# EasyEDA Pro project wukong01-Y003-HTOL - 2.eprj, board PCB1 (continued)
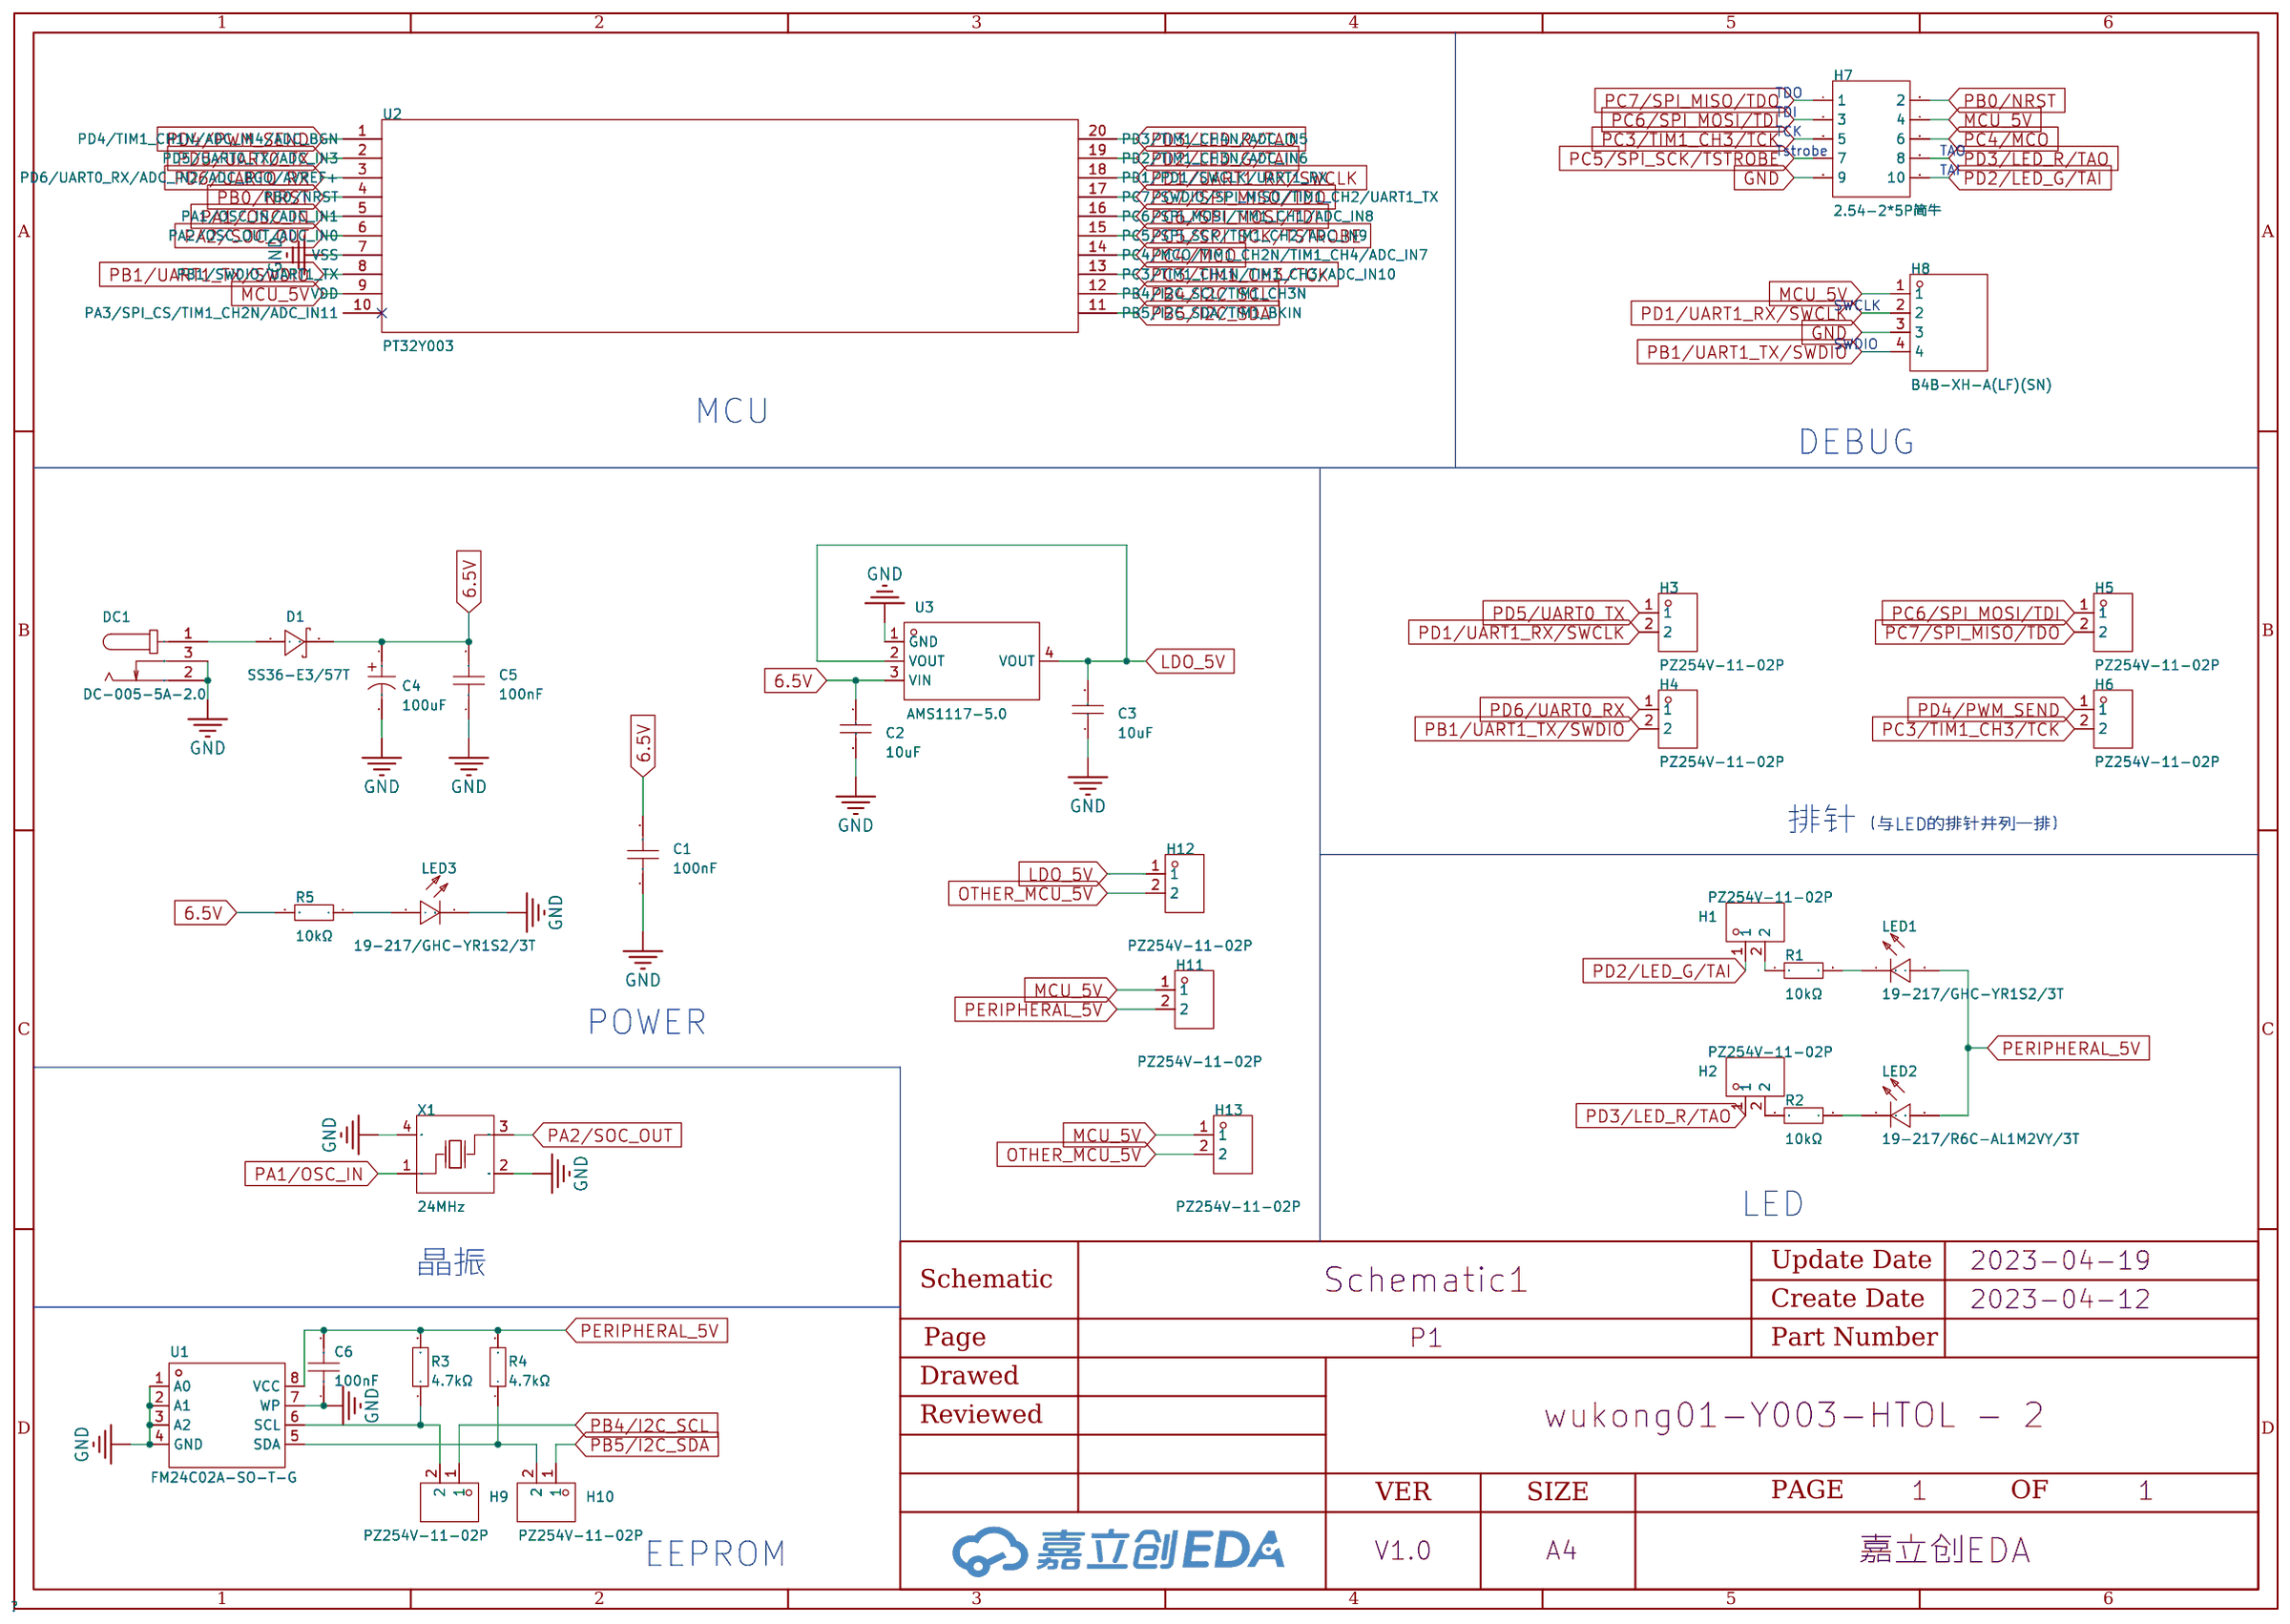
[diagram p0: schematic sheet]
## Routing (per net, layer and track width the routed paths; a pad name or vN(x,y) marks a point on that pad's centre or on a via; arc(x,y) is an arc through that point) (continued)
$1N15897: length 1646.5
  Top Layer w0.254: 247.2,51.71 v1(249.76,51.71) 252.17,51.71 R3#28.1 ; v1(252.81,124.28) v1(249.89,124.28) ; R3#10.1 252.17,165.71 v1(249.76,165.71) 247.2,165.71 ; v1(279.1,49.17) 280.75,50.82 280.75,56.53 279.23,58.06 H9#27.2 ; 157.2,127.71 v1(159.76,127.71) 162.17,127.71 R3#11.1 ; v1(144.1,87.17) 145.75,88.82 145.75,94.53 144.23,96.06 H9#19.2 ; H9#2.2 144.23,210.06 145.75,208.53 145.75,202.82 v1(144.1,201.17) ; v1(72.81,162.28) v1(69.89,162.28) ; v1(72.81,200.28) v1(69.89,200.28) ; R3#19.1 207.17,89.71 v1(204.76,89.71) 202.2,89.71 ; v1(72.81,86.28) v1(69.89,86.28) ; R3#2.1 117.17,203.71 v1(114.77,203.71) U1#2.6 ; v1(189.1,125.17) 190.75,126.82 190.75,132.53 189.23,134.06 H9#14.2 ; H9#13.2 144.23,134.06 145.75,132.53 145.75,126.82 v1(144.1,125.17) ; v1(27.81,124.28) v1(24.89,124.28) ; U1#10.6 v1(24.77,165.71) 27.17,165.71 R3#9.1 ; v1(72.81,10.28) v1(69.89,10.28) ; v1(27.81,86.28) v1(24.89,86.28) ; R3#13.1 207.17,127.71 v1(204.76,127.71) 202.2,127.71 ; H9.2 99.23,210.06 100.75,208.53 100.75,202.82 v1(99.1,201.17) ; v1(99.1,163.17) 100.75,164.82 100.75,170.53 99.23,172.06 H9#6.2 ; v1(279.1,87.17) 280.75,88.82 280.75,94.53 279.23,96.06 H9#21.2 ; H9#30.2 99.23,20.06 100.75,18.53 100.75,12.82 v1(99.1,11.17) ; U1#24.6 v1(69.77,51.71) 72.17,51.71 R3#26.1 ; v1(162.81,200.28) v1(159.89,200.28) ; v1(54.1,87.17) 55.75,88.82 55.75,94.53 54.23,96.06 H9#22.2 ; v1(162.81,48.28) v1(159.89,48.28) ; H9#17.2 234.23,96.06 235.75,94.53 235.75,88.82 v1(234.1,87.17) ; R3#5.1 162.17,165.71 v1(159.76,165.71) 157.2,165.71 ; H9#18.2 99.23,96.06 100.75,94.53 100.75,88.82 v1(99.1,87.17) ; H9#28.2 54.23,58.06 55.75,56.53 55.75,50.82 v1(54.1,49.17) ; v1(234.1,49.17) 235.75,50.82 235.75,56.53 234.23,58.06 H9#23.2 ; v1(252.81,162.28) v1(249.89,162.28) ; 202.2,51.71 v1(204.76,51.71) 207.17,51.71 R3#25.1 ; R3#3.1 162.17,203.71 v1(159.76,203.71) 157.2,203.71 ; H9#25.2 144.23,58.06 145.75,56.53 145.75,50.82 v1(144.1,49.17) ; R3#32.1 72.17,13.71 v1(69.77,13.71) U1#29.6 ; 202.2,13.71 v1(204.76,13.71) 207.17,13.71 R3#31.1 ; v1(54.1,125.17) 55.75,126.82 55.75,132.53 54.23,134.06 H9#16.2 ; v1(72.81,124.28) v1(69.89,124.28) ; R3#21.1 27.17,89.71 v1(24.77,89.71) U1#22.6 ; v1(189.1,11.17) 190.75,12.82 190.75,18.53 189.23,20.06 H9#32.2 ; H9#4.2 234.23,210.06 235.75,208.53 235.75,202.82 v1(234.1,201.17) ; v1(162.81,124.28) v1(159.89,124.28) ; v1(117.81,48.28) v1(114.89,48.28) ; v1(189.1,49.17) 190.75,50.82 190.75,56.53 189.23,58.06 H9#26.2 ; R3#24.1 117.17,51.71 v1(114.77,51.71) U1#25.6 ; R3#8.1 72.17,165.71 v1(69.77,165.71) U1#6.6 ; 247.2,89.71 v1(249.76,89.71) 252.17,89.71 R3#22.1 ; v1(27.81,162.28) v1(24.89,162.28) ; v1(27.81,48.28) v1(24.89,48.28) ; v1(117.81,162.28) v1(114.89,162.28) ; H9#31.2 144.23,20.06 145.75,18.53 145.75,12.82 v1(144.1,11.17) ; H9#12.2 99.23,134.06 100.75,132.53 100.75,126.82 v1(99.1,125.17) ; v1(162.81,162.28) v1(159.89,162.28) ; v1(207.81,10.28) v1(204.89,10.28) ; v1(117.81,10.28) v1(114.89,10.28) ; R3#27.1 27.17,51.71 v1(24.77,51.71) U1#28.6 ; v1(234.1,11.17) 235.75,12.82 235.75,18.53 234.23,20.06 H9#29.2 ; v1(162.81,10.28) v1(159.89,10.28) ; U1#12.6 v1(69.77,127.71) 72.17,127.71 R3#14.1 ; v1(252.81,48.28) v1(249.89,48.28) ; v1(234.1,125.17) 235.75,126.82 235.75,132.53 234.23,134.06 H9#11.2 ; v1(189.1,201.17) 190.75,202.82 190.75,208.53 189.23,210.06 H9#3.2 ; H9#10.2 54.23,172.06 55.75,170.53 55.75,164.82 v1(54.1,163.17) ; R3#29.1 162.17,13.71 v1(159.76,13.71) 157.2,13.71 ; R3#20.1 72.17,89.71 v1(69.77,89.71) U1#18.6 ; R3#30.1 117.17,13.71 v1(114.77,13.71) U1#30.6 ; v1(99.1,49.17) 100.75,50.82 100.75,56.53 99.23,58.06 H9#24.2 ; H9#9.2 279.23,172.06 280.75,170.53 280.75,164.82 v1(279.1,163.17) ; R3#18.1 117.17,89.71 v1(114.77,89.71) U1#19.6 ; v1(207.81,162.28) v1(204.89,162.28) ; 247.2,127.71 v1(249.76,127.71) 252.17,127.71 R3#16.1 ; v1(72.81,48.28) v1(69.89,48.28) ; R3#23.1 162.17,51.71 v1(159.76,51.71) 157.2,51.71 ; v1(189.1,87.17) 190.75,88.82 190.75,94.53 189.23,96.06 H9#20.2 ; v1(117.81,200.28) v1(114.89,200.28) ; R3#4.1 207.17,203.71 v1(204.76,203.71) 202.2,203.71 ; v1(207.81,48.28) v1(204.89,48.28) ; 157.2,89.71 v1(159.76,89.71) 162.17,89.71 R3#17.1 ; H9#15.2 279.23,134.06 280.75,132.53 280.75,126.82 v1(279.1,125.17) ; v1(144.1,163.17) 145.75,164.82 145.75,170.53 144.23,172.06 H9#7.2 ; v1(162.81,86.28) v1(159.89,86.28) ; R3#12.1 117.17,127.71 v1(114.77,127.71) U1#13.6 ; R3#6.1 117.17,165.71 v1(114.77,165.71) U1#7.6 ; v1(252.81,86.28) v1(249.89,86.28) ; H9#8.2 189.23,172.06 190.75,170.53 190.75,164.82 v1(189.1,163.17) ; R3.1 72.17,203.71 v1(69.77,203.71) U1.6 ; R3#7.1 207.17,165.71 v1(204.76,165.71) 202.2,165.71 ; v1(234.1,163.17) 235.75,164.82 235.75,170.53 234.23,172.06 H9#5.2 ; v1(207.81,124.28) v1(204.89,124.28) ; v1(207.81,86.28) v1(204.89,86.28) ; v1(117.81,124.28) v1(114.89,124.28) ; U1#16.6 v1(24.77,127.71) 27.17,127.71 R3#15.1 ; v1(117.81,86.28) v1(114.89,86.28) ; v1(207.81,200.28) v1(204.89,200.28)
  Bottom Layer w0.254: v1(99.1,87.17) 98.21,86.28 v1(72.81,86.28) ; v1(204.76,13.71) 204.89,13.58 v1(204.89,10.28) ; v1(69.77,13.71) 69.89,13.58 v1(69.89,10.28) ; v1(114.77,89.71) 114.89,89.58 v1(114.89,86.28) ; v1(69.77,89.71) 69.89,89.58 v1(69.89,86.28) ; v1(69.89,200.28) 69.89,203.58 v1(69.77,203.71) ; v1(252.81,48.28) 278.21,48.28 v1(279.1,49.17) ; v1(117.81,86.28) 143.21,86.28 v1(144.1,87.17) ; v1(114.77,13.71) 114.89,13.58 v1(114.89,10.28) ; v1(249.76,51.71) 249.89,51.58 v1(249.89,48.28) ; v1(117.81,10.28) 143.21,10.28 v1(144.1,11.17) ; v1(204.89,48.28) 204.89,51.58 v1(204.76,51.71) ; v1(99.1,125.17) 98.21,124.28 v1(72.81,124.28) ; v1(249.89,86.28) 249.89,89.58 v1(249.76,89.71) ; v1(24.89,124.28) 24.89,127.58 v1(24.77,127.71) ; v1(114.77,165.71) 114.89,165.58 v1(114.89,162.28) ; v1(189.1,125.17) 188.21,124.28 v1(162.81,124.28) ; v1(54.1,125.17) 53.21,124.28 v1(27.81,124.28) ; v1(159.76,165.71) 159.89,165.58 v1(159.89,162.28) ; v1(24.77,165.71) 24.89,165.58 v1(24.89,162.28) ; v1(249.89,124.28) 249.89,127.58 v1(249.76,127.71) ; v1(234.1,163.17) 233.21,162.28 v1(207.81,162.28) ; v1(234.1,87.17) 233.21,86.28 v1(207.81,86.28) ; v1(204.89,86.28) 204.89,89.58 v1(204.76,89.71) ; v1(252.81,124.28) 278.21,124.28 v1(279.1,125.17) ; v1(144.1,49.17) 143.21,48.28 v1(117.81,48.28) ; v1(54.1,87.17) 53.21,86.28 v1(27.81,86.28) ; v1(204.89,162.28) 204.89,165.58 v1(204.76,165.71) ; v1(234.1,201.17) 233.21,200.28 v1(207.81,200.28) ; v1(24.77,89.71) 24.89,89.58 v1(24.89,86.28) ; v1(159.89,86.28) 159.89,89.58 v1(159.76,89.71) ; v1(189.1,201.17) 188.21,200.28 v1(162.81,200.28) ; v1(72.81,48.28) 98.21,48.28 v1(99.1,49.17) ; v1(114.89,48.28) 114.89,51.58 v1(114.77,51.71) ; v1(27.81,162.28) 53.21,162.28 v1(54.1,163.17) ; v1(252.81,86.28) 278.21,86.28 v1(279.1,87.17) ; v1(159.89,124.28) 159.89,127.58 v1(159.76,127.71) ; v1(189.1,11.17) 188.21,10.28 v1(162.81,10.28) ; v1(117.81,124.28) 143.21,124.28 v1(144.1,125.17) ; v1(189.1,87.17) 188.21,86.28 v1(162.81,86.28) ; v1(234.1,125.17) 233.21,124.28 v1(207.81,124.28) ; v1(204.89,124.28) 204.89,127.58 v1(204.76,127.71) ; v1(159.76,203.71) 159.89,203.58 v1(159.89,200.28) ; v1(207.81,48.28) 233.21,48.28 v1(234.1,49.17) ; v1(144.1,163.17) 143.21,162.28 v1(117.81,162.28) ; v1(99.1,11.17) 98.21,10.28 v1(72.81,10.28) ; v1(24.89,48.28) 24.89,51.58 v1(24.77,51.71) ; v1(279.1,163.17) 278.21,162.28 v1(252.81,162.28) ; v1(234.1,11.17) 233.21,10.28 v1(207.81,10.28) ; v1(162.81,162.28) 188.21,162.28 v1(189.1,163.17) ; v1(204.89,200.28) 204.89,203.58 v1(204.76,203.71) ; v1(54.1,49.17) 53.21,48.28 v1(27.81,48.28) ; v1(144.1,201.17) 143.21,200.28 v1(117.81,200.28) ; v1(69.77,127.71) 69.89,127.58 v1(69.89,124.28) ; v1(249.89,162.28) 249.89,165.58 v1(249.76,165.71) ; v1(69.77,51.71) 69.89,51.58 v1(69.89,48.28) ; v1(72.81,200.28) 98.21,200.28 v1(99.1,201.17) ; v1(69.77,165.71) 69.89,165.58 v1(69.89,162.28) ; v1(72.81,162.28) 98.21,162.28 v1(99.1,163.17) ; v1(114.89,200.28) 114.89,203.58 v1(114.77,203.71) ; v1(159.89,10.28) 159.89,13.58 v1(159.76,13.71) ; v1(159.89,48.28) 159.89,51.58 v1(159.76,51.71) ; v1(189.1,49.17) 188.21,48.28 v1(162.81,48.28) ; v1(114.89,124.28) 114.89,127.58 v1(114.77,127.71)

## Copper pours and planes (outline as drawn; the poured copper is in the pictures)
GND on Bottom Layer: 0,240 290,240 290,0 0,0

## Text on the board
Top Silkscreen Layer: 澎湃微电子
